# EasyEDA Pro project wukong01-Y003-HTOL - 2.eprj, board PCB1 (continued)
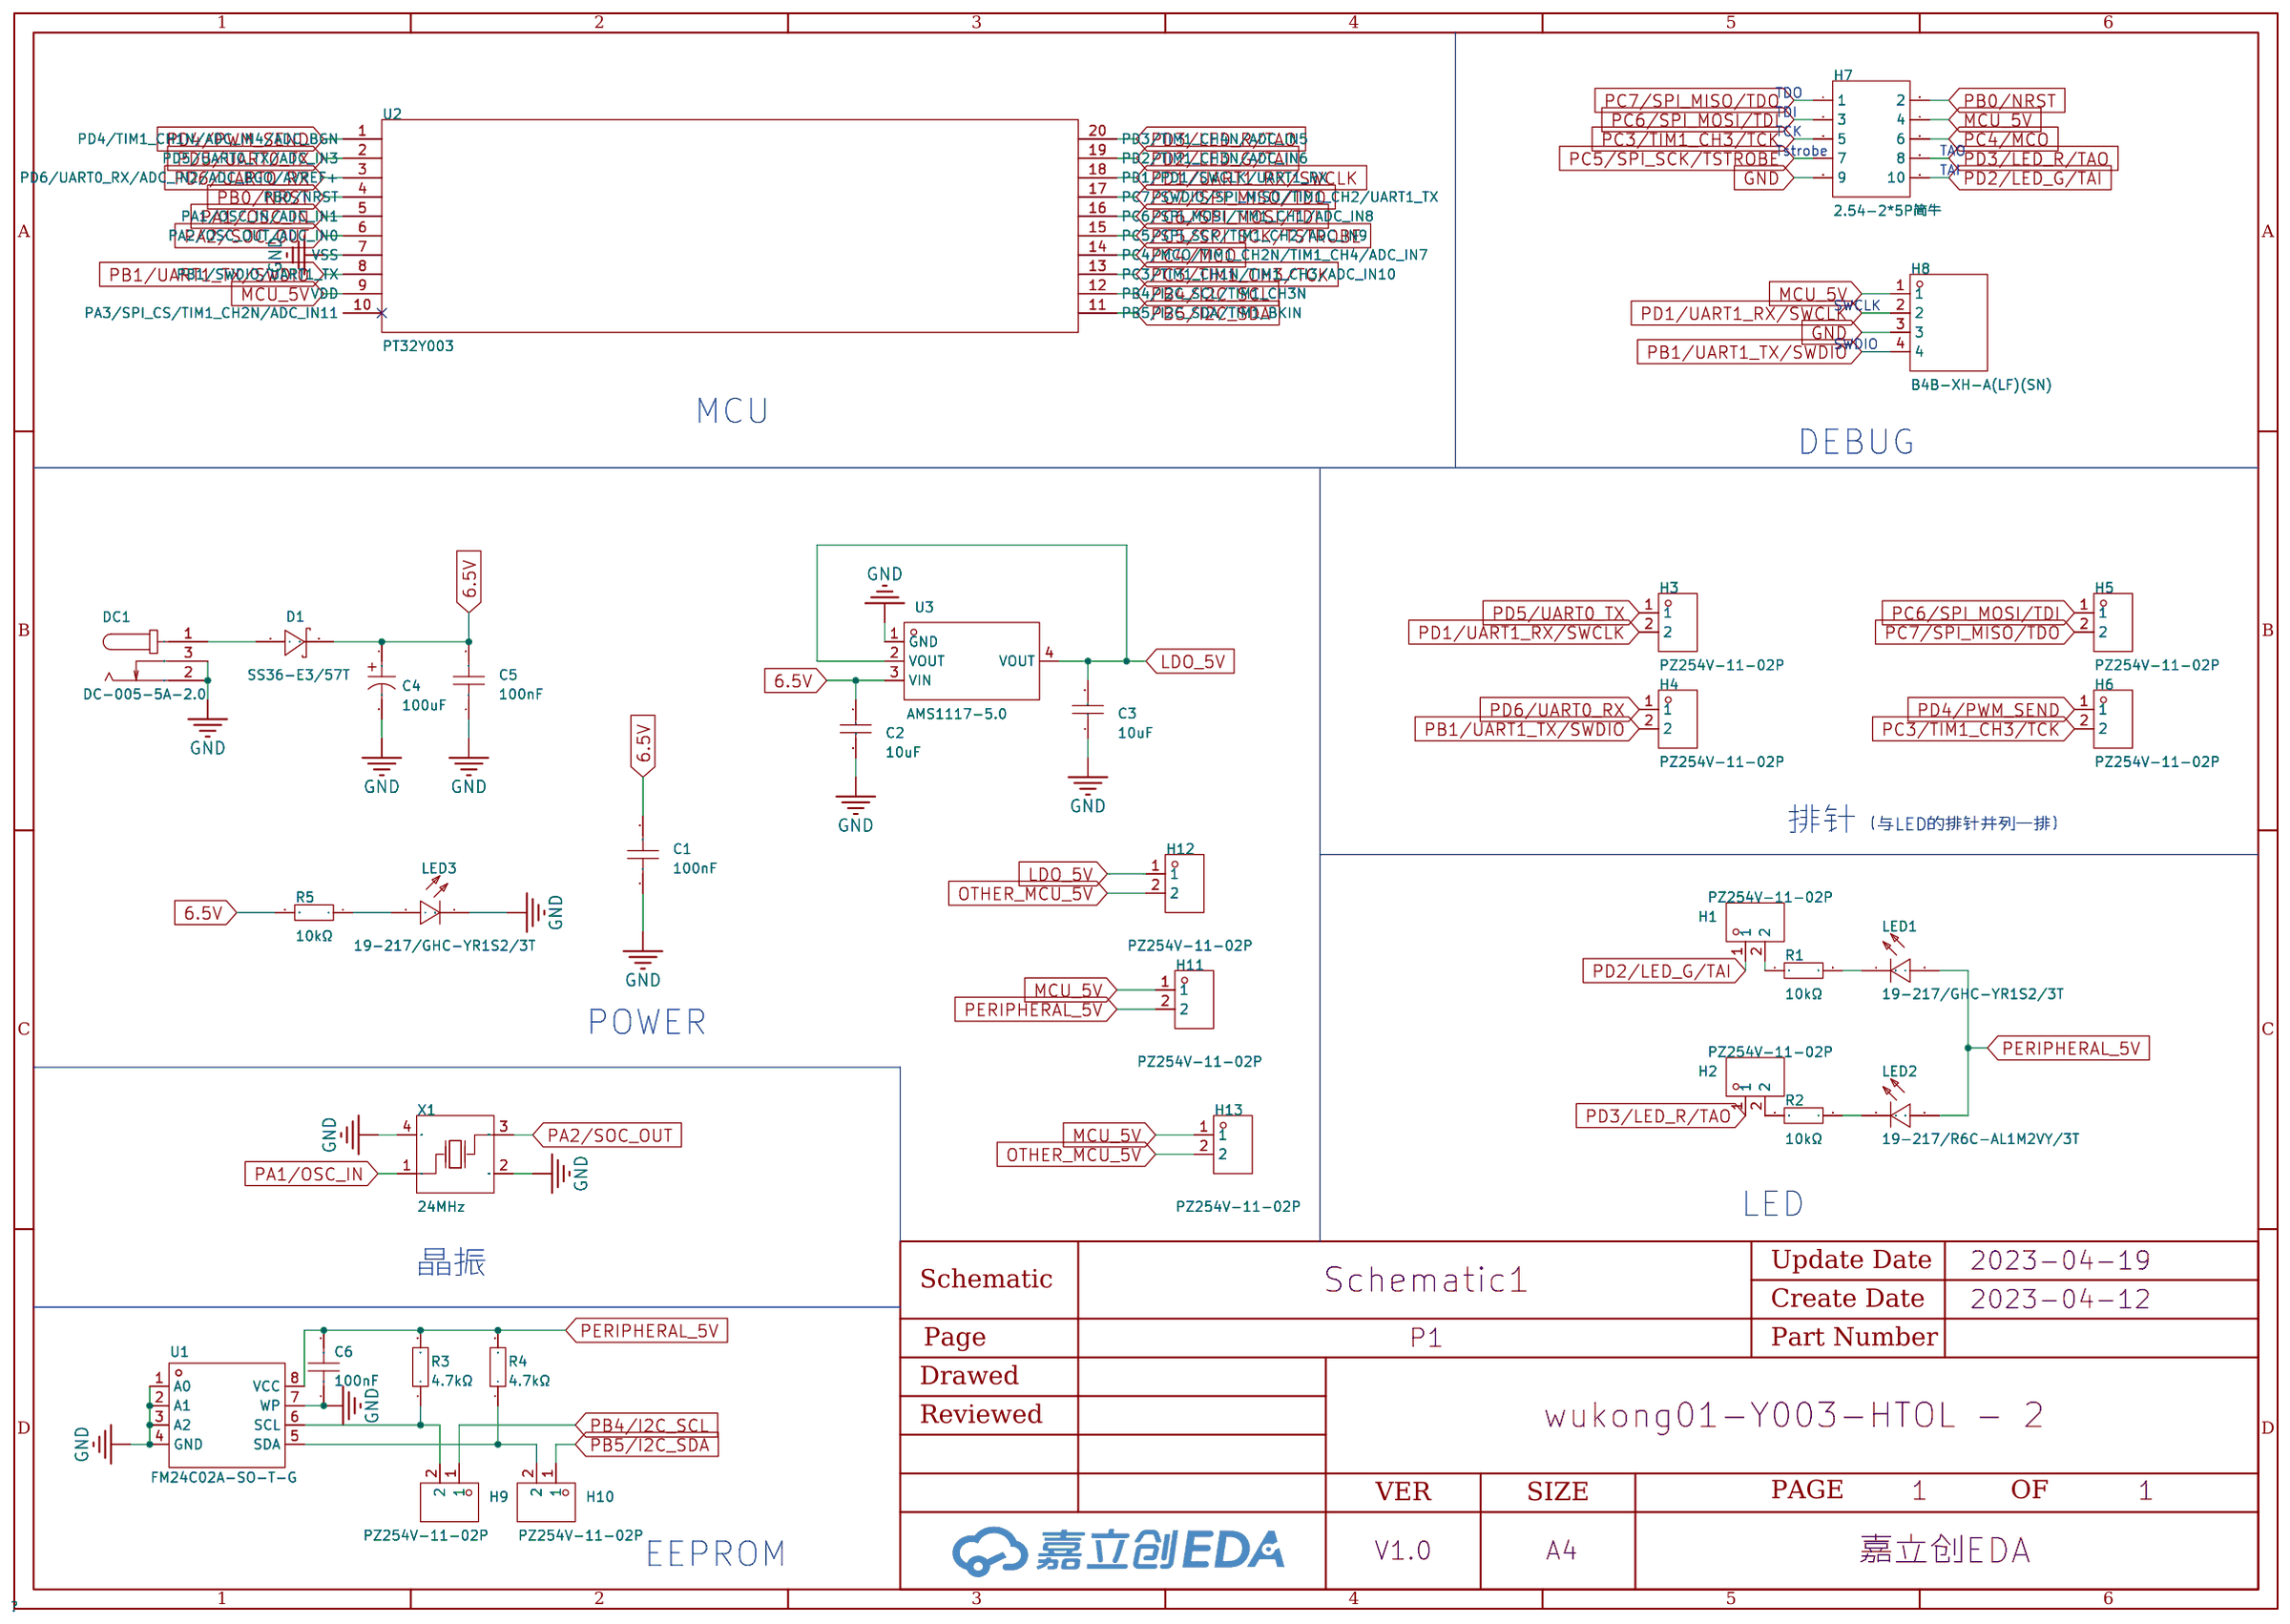
[diagram p0: schematic sheet]
## Nets (continued)
PC6/SPI_MOSI/TDI: H5.1 H5#2.1 H5#3.1 H5#4.1 H5#5.1 H5#6.1 H5#7.1 H5#8.1 H5#9.1 H5#10.1 H5#11.1 H5#12.1 H5#13.1 H5#14.1 H5#15.1 H5#16.1 H5#17.1 H5#18.1 H5#19.1 H5#20.1 H5#21.1 H5#22.1 H5#23.1 H5#24.1 H5#25.1 H5#26.1 H5#27.1 H5#28.1 H5#29.1 H5#30.1 H5#31.1 H5#32.1 H7.3 H7#2.3 H7#3.3 H7#4.3 H7#5.3 H7#6.3 H7#7.3 H7#8.3 H7#9.3 H7#10.3 H7#11.3 H7#12.3 H7#13.3 H7#14.3 H7#15.3 H7#16.3 H7#17.3 H7#18.3 H7#19.3 H7#20.3 H7#21.3 H7#22.3 H7#23.3 H7#24.3 H7#25.3 H7#26.3 H7#27.3 H7#28.3 H7#29.3 H7#30.3 H7#31.3 H7#32.3 U2.16 U2#2.16 U2#3.16 U2#4.16 U2#5.16 U2#6.16 U2#7.16 U2#8.16 U2#9.16 U2#10.16 U2#11.16 U2#12.16 U2#13.16 U2#14.16 U2#15.16 U2#16.16 U2#17.16 U2#18.16 U2#19.16 U2#20.16 U2#21.16 U2#22.16 U2#23.16 U2#24.16 U2#25.16 U2#26.16 U2#27.16 U2#28.16 U2#29.16 U2#30.16 U2#31.16 U2#32.16
PC7/SPI_MISO/TDO: H5.2 H5#2.2 H5#3.2 H5#4.2 H5#5.2 H5#6.2 H5#7.2 H5#8.2 H5#9.2 H5#10.2 H5#11.2 H5#12.2 H5#13.2 H5#14.2 H5#15.2 H5#16.2 H5#17.2 H5#18.2 H5#19.2 H5#20.2 H5#21.2 H5#22.2 H5#23.2 H5#24.2 H5#25.2 H5#26.2 H5#27.2 H5#28.2 H5#29.2 H5#30.2 H5#31.2 H5#32.2 H7.1 H7#2.1 H7#3.1 H7#4.1 H7#5.1 H7#6.1 H7#7.1 H7#8.1 H7#9.1 H7#10.1 H7#11.1 H7#12.1 H7#13.1 H7#14.1 H7#15.1 H7#16.1 H7#17.1 H7#18.1 H7#19.1 H7#20.1 H7#21.1 H7#22.1 H7#23.1 H7#24.1 H7#25.1 H7#26.1 H7#27.1 H7#28.1 H7#29.1 H7#30.1 H7#31.1 H7#32.1 U2.17 U2#2.17 U2#3.17 U2#4.17 U2#5.17 U2#6.17 U2#7.17 U2#8.17 U2#9.17 U2#10.17 U2#11.17 U2#12.17 U2#13.17 U2#14.17 U2#15.17 U2#16.17 U2#17.17 U2#18.17 U2#19.17 U2#20.17 U2#21.17 U2#22.17 U2#23.17 U2#24.17 U2#25.17 U2#26.17 U2#27.17 U2#28.17 U2#29.17 U2#30.17 U2#31.17 U2#32.17
PD1/UART1_RX/SWCLK: H3.2 H3#2.2 H3#3.2 H3#4.2 H3#5.2 H3#6.2 H3#7.2 H3#8.2 H3#9.2 H3#10.2 H3#11.2 H3#12.2 H3#13.2 H3#14.2 H3#15.2 H3#16.2 H3#17.2 H3#18.2 H3#19.2 H3#20.2 H3#21.2 H3#22.2 H3#23.2 H3#24.2 H3#25.2 H3#26.2 H3#27.2 H3#28.2 H3#29.2 H3#30.2 H3#31.2 H3#32.2 H8.2 H8#2.2 H8#3.2 H8#4.2 H8#5.2 H8#6.2 H8#7.2 H8#8.2 H8#9.2 H8#10.2 H8#11.2 H8#12.2 H8#13.2 H8#14.2 H8#15.2 H8#16.2 H8#17.2 H8#18.2 H8#19.2 H8#20.2 H8#21.2 H8#22.2 H8#23.2 H8#24.2 H8#25.2 H8#26.2 H8#27.2 H8#28.2 H8#29.2 H8#30.2 H8#31.2 H8#32.2 U2.18 U2#2.18 U2#3.18 U2#4.18 U2#5.18 U2#6.18 U2#7.18 U2#8.18 U2#9.18 U2#10.18 U2#11.18 U2#12.18 U2#13.18 U2#14.18 U2#15.18 U2#16.18 U2#17.18 U2#18.18 U2#19.18 U2#20.18 U2#21.18 U2#22.18 U2#23.18 U2#24.18 U2#25.18 U2#26.18 U2#27.18 U2#28.18 U2#29.18 U2#30.18 U2#31.18 U2#32.18
PD2/LED_G/TAI: H1.1 H1#2.1 H1#3.1 H1#4.1 H1#5.1 H1#6.1 H1#7.1 H1#8.1 H1#9.1 H1#10.1 H1#11.1 H1#12.1 H1#13.1 H1#14.1 H1#15.1 H1#16.1 H1#17.1 H1#18.1 H1#19.1 H1#20.1 H1#21.1 H1#22.1 H1#23.1 H1#24.1 H1#25.1 H1#26.1 H1#27.1 H1#28.1 H1#29.1 H1#30.1 H1#31.1 H1#32.1 H7.10 H7#2.10 H7#3.10 H7#4.10 H7#5.10 H7#6.10 H7#7.10 H7#8.10 H7#9.10 H7#10.10 H7#11.10 H7#12.10 H7#13.10 H7#14.10 H7#15.10 H7#16.10 H7#17.10 H7#18.10 H7#19.10 H7#20.10 H7#21.10 H7#22.10 H7#23.10 H7#24.10 H7#25.10 H7#26.10 H7#27.10 H7#28.10 H7#29.10 H7#30.10 H7#31.10 H7#32.10 U2.19 U2#2.19 U2#3.19 U2#4.19 U2#5.19 U2#6.19 U2#7.19 U2#8.19 U2#9.19 U2#10.19 U2#11.19 U2#12.19 U2#13.19 U2#14.19 U2#15.19 U2#16.19 U2#17.19 U2#18.19 U2#19.19 U2#20.19 U2#21.19 U2#22.19 U2#23.19 U2#24.19 U2#25.19 U2#26.19 U2#27.19 U2#28.19 U2#29.19 U2#30.19 U2#31.19 U2#32.19
PD3/LED_R/TAO: H2.1 H2#2.1 H2#3.1 H2#4.1 H2#5.1 H2#6.1 H2#7.1 H2#8.1 H2#9.1 H2#10.1 H2#11.1 H2#12.1 H2#13.1 H2#14.1 H2#15.1 H2#16.1 H2#17.1 H2#18.1 H2#19.1 H2#20.1 H2#21.1 H2#22.1 H2#23.1 H2#24.1 H2#25.1 H2#26.1 H2#27.1 H2#28.1 H2#29.1 H2#30.1 H2#31.1 H2#32.1 H7.8 H7#2.8 H7#3.8 H7#4.8 H7#5.8 H7#6.8 H7#7.8 H7#8.8 H7#9.8 H7#10.8 H7#11.8 H7#12.8 H7#13.8 H7#14.8 H7#15.8 H7#16.8 H7#17.8 H7#18.8 H7#19.8 H7#20.8 H7#21.8 H7#22.8 H7#23.8 H7#24.8 H7#25.8 H7#26.8 H7#27.8 H7#28.8 H7#29.8 H7#30.8 H7#31.8 H7#32.8 U2.20 U2#2.20 U2#3.20 U2#4.20 U2#5.20 U2#6.20 U2#7.20 U2#8.20 U2#9.20 U2#10.20 U2#11.20 U2#12.20 U2#13.20 U2#14.20 U2#15.20 U2#16.20 U2#17.20 U2#18.20 U2#19.20 U2#20.20 U2#21.20 U2#22.20 U2#23.20 U2#24.20 U2#25.20 U2#26.20 U2#27.20 U2#28.20 U2#29.20 U2#30.20 U2#31.20 U2#32.20
PD4/PWM_SEND: H6.1 H6#2.1 H6#3.1 H6#4.1 H6#5.1 H6#6.1 H6#7.1 H6#8.1 H6#9.1 H6#10.1 H6#11.1 H6#12.1 H6#13.1 H6#14.1 H6#15.1 H6#16.1 H6#17.1 H6#18.1 H6#19.1 H6#20.1 H6#21.1 H6#22.1 H6#23.1 H6#24.1 H6#25.1 H6#26.1 H6#27.1 H6#28.1 H6#29.1 H6#30.1 H6#31.1 H6#32.1 U2.1 U2#2.1 U2#3.1 U2#4.1 U2#5.1 U2#6.1 U2#7.1 U2#8.1 U2#9.1 U2#10.1 U2#11.1 U2#12.1 U2#13.1 U2#14.1 U2#15.1 U2#16.1 U2#17.1 U2#18.1 U2#19.1 U2#20.1 U2#21.1 U2#22.1 U2#23.1 U2#24.1 U2#25.1 U2#26.1 U2#27.1 U2#28.1 U2#29.1 U2#30.1 U2#31.1 U2#32.1
PD5/UART0_TX: H3.1 H3#2.1 H3#3.1 H3#4.1 H3#5.1 H3#6.1 H3#7.1 H3#8.1 H3#9.1 H3#10.1 H3#11.1 H3#12.1 H3#13.1 H3#14.1 H3#15.1 H3#16.1 H3#17.1 H3#18.1 H3#19.1 H3#20.1 H3#21.1 H3#22.1 H3#23.1 H3#24.1 H3#25.1 H3#26.1 H3#27.1 H3#28.1 H3#29.1 H3#30.1 H3#31.1 H3#32.1 U2.2 U2#2.2 U2#3.2 U2#4.2 U2#5.2 U2#6.2 U2#7.2 U2#8.2 U2#9.2 U2#10.2 U2#11.2 U2#12.2 U2#13.2 U2#14.2 U2#15.2 U2#16.2 U2#17.2 U2#18.2 U2#19.2 U2#20.2 U2#21.2 U2#22.2 U2#23.2 U2#24.2 U2#25.2 U2#26.2 U2#27.2 U2#28.2 U2#29.2 U2#30.2 U2#31.2 U2#32.2
PD6/UART0_RX: H4.1 H4#2.1 H4#3.1 H4#4.1 H4#5.1 H4#6.1 H4#7.1 H4#8.1 H4#9.1 H4#10.1 H4#11.1 H4#12.1 H4#13.1 H4#14.1 H4#15.1 H4#16.1 H4#17.1 H4#18.1 H4#19.1 H4#20.1 H4#21.1 H4#22.1 H4#23.1 H4#24.1 H4#25.1 H4#26.1 H4#27.1 H4#28.1 H4#29.1 H4#30.1 H4#31.1 H4#32.1 U2.3 U2#2.3 U2#3.3 U2#4.3 U2#5.3 U2#6.3 U2#7.3 U2#8.3 U2#9.3 U2#10.3 U2#11.3 U2#12.3 U2#13.3 U2#14.3 U2#15.3 U2#16.3 U2#17.3 U2#18.3 U2#19.3 U2#20.3 U2#21.3 U2#22.3 U2#23.3 U2#24.3 U2#25.3 U2#26.3 U2#27.3 U2#28.3 U2#29.3 U2#30.3 U2#31.3 U2#32.3
PERIPHERAL_5V: C6.2 C6#2.2 C6#3.2 C6#4.2 C6#5.2 C6#6.2 C6#7.2 C6#8.2 C6#9.2 C6#10.2 C6#11.2 C6#12.2 C6#13.2 C6#14.2 C6#15.2 C6#16.2 C6#17.2 C6#18.2 C6#19.2 C6#20.2 C6#21.2 C6#22.2 C6#23.2 C6#24.2 C6#25.2 C6#26.2 C6#27.2 C6#28.2 C6#29.2 C6#30.2 C6#31.2 C6#32.2 H11.2 H11#2.2 H11#3.2 H11#4.2 H11#5.2 H11#6.2 H11#7.2 H11#8.2 H11#9.2 H11#10.2 H11#11.2 H11#12.2 H11#13.2 H11#14.2 H11#15.2 H11#16.2 H11#17.2 H11#18.2 H11#19.2 H11#20.2 H11#21.2 H11#22.2 H11#23.2 H11#24.2 H11#25.2 H11#26.2 H11#27.2 H11#28.2 H11#29.2 H11#30.2 H11#31.2 H11#32.2 LED1.2 LED1#2.2 LED1#3.2 LED1#4.2 LED1#5.2 LED1#6.2 LED1#7.2 LED1#8.2 LED1#9.2 LED1#10.2 LED1#11.2 LED1#12.2 LED1#13.2 LED1#14.2 LED1#15.2 LED1#16.2 LED1#17.2 LED1#18.2 LED1#19.2 LED1#20.2 LED1#21.2 LED1#22.2 LED1#23.2 LED1#24.2 LED1#25.2 LED1#26.2 LED1#27.2 LED1#28.2 LED1#29.2 LED1#30.2 LED1#31.2 LED1#32.2 LED2.1 LED2#2.1 LED2#3.1 LED2#4.1 LED2#5.1 LED2#6.1 LED2#7.1 LED2#8.1 LED2#9.1 LED2#10.1 LED2#11.1 LED2#12.1 LED2#13.1 LED2#14.1 LED2#15.1 LED2#16.1 LED2#17.1 LED2#18.1 LED2#19.1 LED2#20.1 LED2#21.1 LED2#22.1 LED2#23.1 LED2#24.1 LED2#25.1 LED2#26.1 LED2#27.1 LED2#28.1 LED2#29.1 LED2#30.1 LED2#31.1 LED2#32.1 R3.2 R3#2.2 R3#3.2 R3#4.2 R3#5.2 R3#6.2 R3#7.2 R3#8.2 R3#9.2 R3#10.2 R3#11.2 R3#12.2 R3#13.2 R3#14.2 R3#15.2 R3#16.2 R3#17.2 R3#18.2 R3#19.2 R3#20.2 R3#21.2 R3#22.2 R3#23.2 R3#24.2 R3#25.2 R3#26.2 R3#27.2 R3#28.2 R3#29.2 R3#30.2 R3#31.2 R3#32.2 R4.2 R4#2.2 R4#3.2 R4#4.2 R4#5.2 R4#6.2 R4#7.2 R4#8.2 R4#9.2 R4#10.2 R4#11.2 R4#12.2 R4#13.2 R4#14.2 R4#15.2 R4#16.2 R4#17.2 R4#18.2 R4#19.2 R4#20.2 R4#21.2 R4#22.2 R4#23.2 R4#24.2 R4#25.2 R4#26.2 R4#27.2 R4#28.2 R4#29.2 R4#30.2 R4#31.2 R4#32.2 U1.8 U1#2.8 U1#3.8 U1#4.8 U1#5.8 U1#6.8 U1#7.8 U1#8.8 U1#9.8 U1#10.8 U1#11.8 U1#12.8 U1#13.8 U1#14.8 U1#15.8 U1#16.8 U1#17.8 U1#18.8 U1#19.8 U1#20.8 U1#21.8 U1#22.8 U1#23.8 U1#24.8 U1#25.8 U1#26.8 U1#27.8 U1#28.8 U1#29.8 U1#30.8 U1#31.8 U1#32.8
$1N849: LED1.1 LED1#2.1 LED1#3.1 LED1#4.1 LED1#5.1 LED1#6.1 LED1#7.1 LED1#8.1 LED1#9.1 LED1#10.1 LED1#11.1 LED1#12.1 LED1#13.1 LED1#14.1 LED1#15.1 LED1#16.1 LED1#17.1 LED1#18.1 LED1#19.1 LED1#20.1 LED1#21.1 LED1#22.1 LED1#23.1 LED1#24.1 LED1#25.1 LED1#26.1 LED1#27.1 LED1#28.1 LED1#29.1 LED1#30.1 LED1#31.1 LED1#32.1 R1.2 R1#2.2 R1#3.2 R1#4.2 R1#5.2 R1#6.2 R1#7.2 R1#8.2 R1#9.2 R1#10.2 R1#11.2 R1#12.2 R1#13.2 R1#14.2 R1#15.2 R1#16.2 R1#17.2 R1#18.2 R1#19.2 R1#20.2 R1#21.2 R1#22.2 R1#23.2 R1#24.2 R1#25.2 R1#26.2 R1#27.2 R1#28.2 R1#29.2 R1#30.2 R1#31.2 R1#32.2
$1N852: LED2.2 LED2#2.2 LED2#3.2 LED2#4.2 LED2#5.2 LED2#6.2 LED2#7.2 LED2#8.2 LED2#9.2 LED2#10.2 LED2#11.2 LED2#12.2 LED2#13.2 LED2#14.2 LED2#15.2 LED2#16.2 LED2#17.2 LED2#18.2 LED2#19.2 LED2#20.2 LED2#21.2 LED2#22.2 LED2#23.2 LED2#24.2 LED2#25.2 LED2#26.2 LED2#27.2 LED2#28.2 LED2#29.2 LED2#30.2 LED2#31.2 LED2#32.2 R2.2 R2#2.2 R2#3.2 R2#4.2 R2#5.2 R2#6.2 R2#7.2 R2#8.2 R2#9.2 R2#10.2 R2#11.2 R2#12.2 R2#13.2 R2#14.2 R2#15.2 R2#16.2 R2#17.2 R2#18.2 R2#19.2 R2#20.2 R2#21.2 R2#22.2 R2#23.2 R2#24.2 R2#25.2 R2#26.2 R2#27.2 R2#28.2 R2#29.2 R2#30.2 R2#31.2 R2#32.2
$1N3085: H1.2 H1#2.2 H1#3.2 H1#4.2 H1#5.2 H1#6.2 H1#7.2 H1#8.2 H1#9.2 H1#10.2 H1#11.2 H1#12.2 H1#13.2 H1#14.2 H1#15.2 H1#16.2 H1#17.2 H1#18.2 H1#19.2 H1#20.2 H1#21.2 H1#22.2 H1#23.2 H1#24.2 H1#25.2 H1#26.2 H1#27.2 H1#28.2 H1#29.2 H1#30.2 H1#31.2 H1#32.2 R1.1 R1#2.1 R1#3.1 R1#4.1 R1#5.1 R1#6.1 R1#7.1 R1#8.1 R1#9.1 R1#10.1 R1#11.1 R1#12.1 R1#13.1 R1#14.1 R1#15.1 R1#16.1 R1#17.1 R1#18.1 R1#19.1 R1#20.1 R1#21.1 R1#22.1 R1#23.1 R1#24.1 R1#25.1 R1#26.1 R1#27.1 R1#28.1 R1#29.1 R1#30.1 R1#31.1 R1#32.1
$1N3176: H2.2 H2#2.2 H2#3.2 H2#4.2 H2#5.2 H2#6.2 H2#7.2 H2#8.2 H2#9.2 H2#10.2 H2#11.2 H2#12.2 H2#13.2 H2#14.2 H2#15.2 H2#16.2 H2#17.2 H2#18.2 H2#19.2 H2#20.2 H2#21.2 H2#22.2 H2#23.2 H2#24.2 H2#25.2 H2#26.2 H2#27.2 H2#28.2 H2#29.2 H2#30.2 H2#31.2 H2#32.2 R2.1 R2#2.1 R2#3.1 R2#4.1 R2#5.1 R2#6.1 R2#7.1 R2#8.1 R2#9.1 R2#10.1 R2#11.1 R2#12.1 R2#13.1 R2#14.1 R2#15.1 R2#16.1 R2#17.1 R2#18.1 R2#19.1 R2#20.1 R2#21.1 R2#22.1 R2#23.1 R2#24.1 R2#25.1 R2#26.1 R2#27.1 R2#28.1 R2#29.1 R2#30.1 R2#31.1 R2#32.1
$1N6085: LED3.2 R5.1
$1N6296: D1.1 DC1.1
$1N15873: H10.2 H10#2.2 H10#3.2 H10#4.2 H10#5.2 H10#6.2 H10#7.2 H10#8.2 H10#9.2 H10#10.2 H10#11.2 H10#12.2 H10#13.2 H10#14.2 H10#15.2 H10#16.2 H10#17.2 H10#18.2 H10#19.2 H10#20.2 H10#21.2 H10#22.2 H10#23.2 H10#24.2 H10#25.2 H10#26.2 H10#27.2 H10#28.2 H10#29.2 H10#30.2 H10#31.2 H10#32.2 R4.1 R4#2.1 R4#3.1 R4#4.1 R4#5.1 R4#6.1 R4#7.1 R4#8.1 R4#9.1 R4#10.1 R4#11.1 R4#12.1 R4#13.1 R4#14.1 R4#15.1 R4#16.1 R4#17.1 R4#18.1 R4#19.1 R4#20.1 R4#21.1 R4#22.1 R4#23.1 R4#24.1 R4#25.1 R4#26.1 R4#27.1 R4#28.1 R4#29.1 R4#30.1 R4#31.1 R4#32.1 U1.5 U1#2.5 U1#3.5 U1#4.5 U1#5.5 U1#6.5 U1#7.5 U1#8.5 U1#9.5 U1#10.5 U1#11.5 U1#12.5 U1#13.5 U1#14.5 U1#15.5 U1#16.5 U1#17.5 U1#18.5 U1#19.5 U1#20.5 U1#21.5 U1#22.5 U1#23.5 U1#24.5 U1#25.5 U1#26.5 U1#27.5 U1#28.5 U1#29.5 U1#30.5 U1#31.5 U1#32.5
$1N15897: H9.2 H9#2.2 H9#3.2 H9#4.2 H9#5.2 H9#6.2 H9#7.2 H9#8.2 H9#9.2 H9#10.2 H9#11.2 H9#12.2 H9#13.2 H9#14.2 H9#15.2 H9#16.2 H9#17.2 H9#18.2 H9#19.2 H9#20.2 H9#21.2 H9#22.2 H9#23.2 H9#24.2 H9#25.2 H9#26.2 H9#27.2 H9#28.2 H9#29.2 H9#30.2 H9#31.2 H9#32.2 R3.1 R3#2.1 R3#3.1 R3#4.1 R3#5.1 R3#6.1 R3#7.1 R3#8.1 R3#9.1 R3#10.1 R3#11.1 R3#12.1 R3#13.1 R3#14.1 R3#15.1 R3#16.1 R3#17.1 R3#18.1 R3#19.1 R3#20.1 R3#21.1 R3#22.1 R3#23.1 R3#24.1 R3#25.1 R3#26.1 R3#27.1 R3#28.1 R3#29.1 R3#30.1 R3#31.1 R3#32.1 U1.6 U1#2.6 U1#3.6 U1#4.6 U1#5.6 U1#6.6 U1#7.6 U1#8.6 U1#9.6 U1#10.6 U1#11.6 U1#12.6 U1#13.6 U1#14.6 U1#15.6 U1#16.6 U1#17.6 U1#18.6 U1#19.6 U1#20.6 U1#21.6 U1#22.6 U1#23.6 U1#24.6 U1#25.6 U1#26.6 U1#27.6 U1#28.6 U1#29.6 U1#30.6 U1#31.6 U1#32.6
$1N18184: J2.1
$1N18185: J1.1

Pads without a net: U2 10; U2#2 10; U2#3 10; U2#4 10; U2#5 10; U2#6 10; U2#7 10; U2#8 10; U2#9 10; U2#10 10; U2#11 10; U2#12 10; U2#13 10; U2#14 10; U2#15 10; U2#16 10; U2#17 10; U2#18 10; U2#19 10; U2#20 10; U2#21 10; U2#22 10; U2#23 10; U2#24 10; U2#25 10; U2#26 10; U2#27 10; U2#28 10; U2#29 10; U2#30 10; U2#31 10; U2#32 10

## Via types
v1: diameter 0.61, hole 0.305, Top Layer to Bottom Layer, 2026 vias

## Routing (per net, layer and track width the routed paths; a pad name or vN(x,y) marks a point on that pad's centre or on a via; arc(x,y) is an arc through that point)
6.5V: length 88.5
  Top Layer w0.5: 35.17,205.37 35.17,209.08 35.26,209.17 ; 53.34,209.17 35.26,209.17 ; 53.34,209.17 53.34,212.09 44.39,221.04 U3#4.3 44.37,224.54 D1.2 28.45,217.43 C4.1 ; 53.34,209.17 53.34,205.56 U3#3.3 ; 35.26,209.17 18.92,209.17 17.91,208.15 17.91,205.13 U3.3
GND: length 4404.9
  Top Layer w0.5: U1#4.2 U1#4.1 196.38,206.27 v1(196.38,208.28) ; U1#4.2 206.48,204.98 207.24,205.74 ; U1#4.2 U1#4.3 U1#4.4 196.4,194.06 ; U1#12.2 U1#12.3 U1#12.4 61.4,118.06 ; U1#12.2 U1#12.7 71.48,128.98 C6#11.1 ; U1#12.2 U1#12.1 61.38,130.27 v1(61.38,132.28) ; 14.73,212.09 C4.2 32.28,212.09 ; 14.73,212.09 DC1.3 14.73,221.47 DC1.2 11.73,225.98 14.99,229.23 44.27,229.23 U3#4.1 45.2,229.94 C3#4.1 ; 14.73,212.09 7.74,212.09 2.92,207.26 v1(2.92,197.36) ; H7#22.9 253.7,109.52 H8#22.3 241.38,109.52 v1(241.38,98.83) 243.69,98.83 X1#22.2 ; U1#22.2 U1#22.1 16.38,92.27 v1(16.38,94.28) ; U1#22.2 U1#22.3 U1#22.4 16.4,80.14 ; U1#22.2 U1#22.7 26.48,90.98 27.24,91.74 ; v1(248.2,135.07) 245.95,135.07 X1#16.4 ; X1#18.4 20.95,97.07 v1(23.2,97.07) ; 207.24,91.74 206.48,90.98 U1#21.2 ; U2#23.7 v1(72.31,58.61) ; U1#14.2 161.48,128.98 162.24,129.74 ; U1#14.2 U1#14.3 U1#14.4 151.4,118.06 ; U1#14.2 U1#14.1 151.38,130.27 v1(151.38,132.28) ; v1(68.2,135.07) 65.95,135.07 X1#15.4 ; 27.24,167.74 26.48,166.98 U1#10.7 U1#10.2 ; U1#10.2 U1#10.3 U1#10.4 16.4,156.06 ; U1#10.2 U1#10.1 16.38,168.27 v1(16.38,170.28) ; X1#31.4 155.95,21.07 v1(158.2,21.07) ; H7#13.9 163.7,147.52 H8#15.3 151.38,147.52 v1(151.38,136.83) 153.69,136.83 X1#14.2 ; C6#23.1 71.48,52.98 U1#24.7 U1#24.2 ; v1(61.38,18.28) 61.38,16.27 U1#29.1 U1#29.2 ; v1(113.2,97.07) 110.95,97.07 X1#17.4 ; H7#19.9 163.7,109.52 H8#21.3 151.38,109.52 v1(151.38,98.83) 153.69,98.83 X1#20.2 ; U1.2 U1.3 U1.4 61.4,194.06 ; U1.2 U1.1 61.38,206.27 v1(61.38,208.28) ; U1.2 U1.7 71.48,204.98 C6#2.1 ; U1#29.2 U1#29.7 71.48,14.98 C6#29.1 ; U1#29.2 U1#29.3 U1#29.4 61.4,4.82 62.41,3.81 240.92,3.81 242.7,5.59 242.7,40.89 241.68,41.91 12.32,41.91 8.64,45.59 8.64,76.83 11.94,80.14 16.4,80.14 ; U1#26.2 U1#26.3 U1#26.4 151.4,42.06 ; U1#26.2 161.48,52.98 162.24,53.74 ; U1#26.2 U1#26.1 151.38,54.27 v1(151.38,56.28) ; H7#27.9 28.7,71.52 H8#26.3 16.38,71.52 v1(16.38,60.83) 18.69,60.83 X1#24.2 ; 196.4,156.06 U1#9.4 U1#9.3 U1#9.2 ; 106.4,4.06 U1#30.4 U1#30.3 U1#30.2 ; U2#19.7 v1(162.3,96.61) ; U1#6.2 U1#6.3 U1#6.4 61.4,156.06 ; U1#6.2 U1#6.7 71.48,166.98 C6#5.1 ; U1#6.2 U1#6.1 61.38,168.27 v1(61.38,170.28) ; U2#14.7 v1(207.3,134.61) ; C6#30.1 116.48,14.98 U1#30.7 U1#30.2 ; U2#24.7 v1(117.31,58.61) ; U2#30.7 v1(117.31,20.61) ; U2#32.7 v1(207.3,20.61) ; H7#11.9 73.7,147.52 H8#11.3 61.38,147.52 v1(61.38,136.83) 63.69,136.83 63.71,136.81 ; 196.4,118.06 U1#15.4 U1#15.3 U1#15.2 ; v1(241.38,132.28) 241.38,130.27 U1#11.1 U1#11.2 ; U2#8.7 v1(207.3,172.61) ; U1#7.2 U1#7.3 U1#7.4 106.4,156.06 ; U1#7.2 U1#7.7 116.48,166.98 C6#6.1 ; U1#7.2 U1#7.1 106.38,168.27 v1(106.38,170.28) ; U1#17.2 U1#17.1 241.38,92.27 v1(241.38,94.28) ; U1#17.2 251.48,90.98 C6#21.1 ; U1#17.2 U1#17.3 U1#17.4 241.4,80.01 ; v1(8.76,197.36) C3.1 ; H7#3.9 163.7,223.52 H8#3.3 151.38,223.52 v1(151.38,212.83) 153.69,212.83 X1#3.2 ; C6#12.1 116.48,128.98 U1#13.7 U1#13.2 ; v1(158.2,211.07) 155.95,211.07 X1#3.4 ; X1#28.2 243.69,60.83 v1(241.38,60.83) 241.38,71.52 H8#28.3 253.7,71.52 H7#28.9 ; U2#4.7 v1(207.3,210.61) ; H7#10.9 253.7,185.52 H8#10.3 241.38,185.52 v1(241.38,174.83) 243.69,174.83 X1#10.2 ; 196.4,194.06 151.4,194.06 ; 196.4,194.06 284.61,194.06 286.38,192.28 286.38,160.53 281.81,155.96 11.3,155.96 8.38,153.03 8.38,121.54 12.06,117.86 283.46,117.86 285.62,115.7 285.62,84.33 281.31,80.01 241.4,80.01 ; X1#18.2 18.69,98.83 v1(16.38,98.83) 16.38,109.52 H8#20.3 28.7,109.52 H7#21.9 ; v1(106.38,94.28) 106.38,92.27 U1#19.1 U1#19.2 ; X1#4.2 198.69,212.83 v1(196.38,212.83) 196.38,223.52 H8#4.3 208.7,223.52 H7#4.9 ; X1#21.4 65.95,97.07 v1(68.2,97.07) ; v1(158.2,135.07) 155.95,135.07 X1#14.4 ; v1(68.2,211.07) 65.95,211.07 X1.4 ; v1(16.38,132.28) 16.38,130.27 U1#16.1 U1#16.2 ; v1(158.2,97.07) 155.95,97.07 X1#20.4 ; U2#2.7 v1(117.31,210.61) ; U1#25.2 U1#25.1 106.38,54.27 v1(106.38,56.28) ; U1#25.2 U1#25.3 U1#25.4 106.4,42.06 ; U1#25.2 U1#25.7 116.48,52.98 C6#24.1 ; U2#28.7 v1(27.3,58.61) ; U1#31.2 U1#31.1 151.38,16.27 v1(151.38,18.28) ; U1#31.2 161.48,14.98 162.24,15.74 ; U1#31.2 U1#31.3 U1#31.4 151.4,4.06 ; v1(158.2,173.07) 155.95,173.07 X1#8.4 ; 106.4,194.06 151.4,194.06 ; 106.4,194.06 U1#2.4 U1#2.3 U1#2.2 ; 106.4,194.06 61.4,194.06 ; 151.4,194.06 U1#3.4 U1#3.3 U1#3.2 ; X1#10.4 245.95,173.07 v1(248.2,173.07) ; C6#15.1 251.48,128.98 U1#11.2 ; 32.28,212.09 32.51,212.32 C2.2 ; 32.28,212.09 35.68,212.09 ; U1#2.2 U1#2.7 116.48,204.98 C6#3.1 ; U1#2.2 U1#2.1 106.38,206.27 v1(106.38,208.28) ; 106.4,80.01 241.4,80.01 ; 106.4,80.01 U1#19.4 U1#19.3 U1#19.2 ; 106.4,80.01 61.53,80.01 61.4,80.14 ; 16.4,118.06 U1#16.4 U1#16.3 U1#16.2 ; X1#9.4 65.95,173.07 v1(68.2,173.07) ; 38.28,212.09 38.23,212.14 C5.1 ; 38.28,212.09 35.68,212.09 ; 38.28,212.09 40.89,212.09 C1.1 ; U1#11.2 U1#11.3 U1#11.4 241.4,118.06 ; 16.4,80.14 16.4,80.06 ; 16.4,80.14 61.4,80.14 ; U2#22.7 v1(27.3,96.61) ; v1(248.2,59.07) 245.95,59.07 X1#28.4 ; X1#30.2 198.69,22.83 v1(196.38,22.83) 196.38,33.52 H8#31.3 208.7,33.52 H7#32.9 ; U2#10.7 v1(27.3,172.61) ; 63.71,174.81 63.69,174.83 v1(61.38,174.83) 61.38,185.52 H8#5.3 73.7,185.52 H7#5.9 ; 108.71,212.81 108.69,212.83 v1(106.38,212.83) 106.38,223.52 H8#2.3 118.7,223.52 H7#2.9 ; U2#27.7 v1(252.31,58.61) ; v1(23.2,135.07) 20.95,135.07 X1#12.4 ; 61.4,80.14 U1#18.4 U1#18.3 U1#18.2 ; 61.4,80.14 61.4,80.06 ; H7#24.9 118.7,71.52 H8#24.3 106.38,71.52 v1(106.38,60.83) 108.69,60.83 108.71,60.81 ; U2#16.7 v1(27.3,134.61) ; X1#6.2 18.69,174.83 v1(16.38,174.83) 16.38,185.52 H8#8.3 28.7,185.52 H7#9.9 ; U1#23.2 251.48,52.98 C6#27.1 ; U1#23.2 U1#23.1 241.38,54.27 v1(241.38,56.28) ; U1#23.2 U1#23.3 U1#23.4 241.4,42.06 ; U2#6.7 v1(117.31,172.61) ; 196.4,4.06 U1#32.4 U1#32.3 U1#32.2 ; U2#11.7 v1(72.31,134.61) ; v1(61.38,94.28) 61.38,92.27 U1#18.1 U1#18.2 ; v1(248.2,97.07) 245.95,97.07 X1#22.4 ; X1#6.4 20.95,173.07 v1(23.2,173.07) ; v1(203.2,59.07) 200.95,59.07 X1#25.4 ; C3#2.1 v1(26.01,197.36) ; U3.1 v1(17.92,197.36) ; U1#13.2 U1#13.3 U1#13.4 106.4,118.06 ; U1#13.2 U1#13.1 106.38,130.27 v1(106.38,132.28) ; U1#30.2 U1#30.1 106.38,16.27 v1(106.38,18.28) ; 35.68,212.09 35.56,212.2 LED3.1 ; 63.71,22.81 63.69,22.83 v1(61.38,22.83) 61.38,33.52 H8#29.3 73.7,33.52 H7#29.9 ; U1#15.2 206.48,128.98 207.24,129.74 ; U1#15.2 U1#15.1 196.38,130.27 v1(196.38,132.28) ; U1#21.2 U1#21.1 196.38,92.27 v1(196.38,94.28) ; U1#21.2 U1#21.3 U1#21.4 196.4,80.06 ; X1#19.4 200.95,97.07 v1(203.2,97.07) ; v1(68.2,59.07) 65.95,59.07 X1#27.4 ; U1#3.2 161.48,204.98 162.24,205.74 ; U1#3.2 U1#3.1 151.38,206.27 v1(151.38,208.28) ; U3#3.1 53.4,199.45 51.31,197.36 v1(50.11,197.36) 50.16,197.3 50.16,195.2 51.31,194.06 61.4,194.06 ; U1#18.2 U1#18.7 71.48,90.98 C6#17.1 ; v1(68.2,21.07) 65.95,21.07 X1#32.4 ; U2#12.7 v1(117.31,134.61) ; H7#15.9 28.7,147.52 H8#14.3 16.38,147.52 v1(16.38,136.83) 18.69,136.83 X1#12.2 ; v1(113.2,173.07) 110.95,173.07 X1#5.4 ; U1#8.2 U1#8.1 151.38,168.27 v1(151.38,170.28) ; U1#8.2 U1#8.3 U1#8.4 151.4,156.06 ; U1#8.2 161.48,166.98 162.24,167.74 ; U1#20.2 U1#20.1 151.38,92.27 v1(151.38,94.28) ; U1#20.2 161.48,90.98 162.24,91.74 ; U1#20.2 U1#20.3 U1#20.4 151.4,80.06 ; X1#23.4 110.95,59.07 v1(113.2,59.07) ; 108.71,136.81 108.69,136.83 v1(106.38,136.83) 106.38,147.52 H8#12.3 118.7,147.52 H7#12.9 ; U2#9.7 v1(252.31,172.61) ; H7#6.9 118.7,185.52 H8#6.3 106.38,185.52 v1(106.38,174.83) 108.69,174.83 108.71,174.81 ; v1(23.2,59.07) 20.95,59.07 X1#24.4 ; v1(113.2,135.07) 110.95,135.07 X1#11.4 ; v1(196.38,170.28) 196.38,168.27 U1#9.1 U1#9.2 ; 35.17,200.77 v1(35.17,197.36) ; X1#31.2 153.69,22.83 v1(151.38,22.83) 151.38,33.52 H8#32.3 163.7,33.52 H7#31.9 ; 207.24,15.74 206.48,14.98 U1#32.2 ; C6#18.1 116.48,90.98 U1#19.7 U1#19.2 ; X1#16.2 243.69,136.83 v1(241.38,136.83) 241.38,147.52 H8#16.3 253.7,147.52 H7#16.9 ; v1(113.2,21.07) 110.95,21.07 X1#29.4 ; v1(203.2,211.07) 200.95,211.07 X1#4.4 ; 61.4,42.06 U1#24.4 U1#24.3 U1#24.2 ; U1#32.2 U1#32.1 196.38,16.27 v1(196.38,18.28) ; H7#7.9 163.7,185.52 H8#9.3 151.38,185.52 v1(151.38,174.83) 153.69,174.83 X1#8.2 ; H7#20.9 208.7,109.52 H8#19.3 196.38,109.52 v1(196.38,98.83) 198.69,98.83 X1#19.2 ; U2#31.7 v1(162.3,20.61) ; U2#26.7 v1(207.3,58.61) ; U2#18.7 v1(117.31,96.61) ; U2.7 v1(72.31,210.61) ; v1(203.2,173.07) 200.95,173.07 X1#7.4 ; H7#18.9 118.7,109.52 H8#18.3 106.38,109.52 v1(106.38,98.83) 108.69,98.83 108.71,98.81 ; H7#14.9 208.7,147.52 H8#13.3 196.38,147.52 v1(196.38,136.83) 198.69,136.83 X1#13.2 ; 16.4,42.06 U1#28.4 U1#28.3 U1#28.2 ; H7#8.9 208.7,185.52 H8#7.3 196.38,185.52 v1(196.38,174.83) 198.69,174.83 X1#7.2 ; C3#3.1 v1(44.24,197.36) ; U1#16.2 U1#16.7 26.48,128.98 27.24,129.74 ; 63.71,60.81 63.69,60.83 v1(61.38,60.83) 61.38,71.52 H8#23.3 73.7,71.52 H7#23.9 ; U1#9.2 206.48,166.98 207.24,167.74 ; X1#30.4 200.95,21.07 v1(203.2,21.07) ; 63.71,98.81 63.69,98.83 v1(61.38,98.83) 61.38,109.52 H8#17.3 73.7,109.52 H7#17.9 ; U2#21.7 v1(252.31,96.61) ; U1#5.2 U1#5.3 U1#5.4 241.4,156.06 ; U1#5.2 251.48,166.98 C6#9.1 ; U1#5.2 U1#5.1 241.38,168.27 v1(241.38,170.28) ; X1#13.4 200.95,135.07 v1(203.2,135.07) ; H7#26.9 208.7,71.52 H8#25.3 196.38,71.52 v1(196.38,60.83) 198.69,60.83 X1#25.2 ; U1#27.2 U1#27.3 U1#27.4 196.4,42.06 ; U1#27.2 U1#27.1 196.38,54.27 v1(196.38,56.28) ; U1#27.2 206.48,52.98 207.24,53.74 ; U1#24.2 U1#24.1 61.38,54.27 v1(61.38,56.28) ; X1#26.2 153.69,60.83 v1(151.38,60.83) 151.38,71.52 H8#27.3 163.7,71.52 H7#25.9 ; X1#2.4 110.95,211.07 v1(113.2,211.07) ; H7.9 73.7,223.52 H8.3 61.38,223.52 v1(61.38,212.83) 63.69,212.83 63.71,212.81 ; U2#17.7 v1(72.31,96.61) ; U2#5.7 v1(72.31,172.61) ; U2#15.7 v1(252.31,134.61) ; U1#28.2 U1#28.1 16.38,54.27 v1(16.38,56.28) ; U1#28.2 U1#28.7 26.48,52.98 27.24,53.74 ; v1(158.2,59.07) 155.95,59.07 X1#26.4 ; 108.71,22.81 108.69,22.83 v1(106.38,22.83) 106.38,33.52 H8#30.3 118.7,33.52 H7#30.9 ; U2#20.7 v1(207.3,96.61) ; U2#13.7 v1(162.3,134.61) ; U2#29.7 v1(72.31,20.61) ; U2#3.7 v1(162.3,210.61) ; U2#25.7 v1(162.3,58.61) ; U2#7.7 v1(162.3,172.61)
  Bottom Layer w0.5: 23.24,94.28 26.8,94.28 27.3,94.79 v1(27.3,96.61) ; 23.24,94.28 v1(16.38,94.28) v1(16.38,98.83) ; 23.24,94.28 23.2,94.32 v1(23.2,97.07) ; 203.24,208.28 v1(196.38,208.28) v1(196.38,212.83) ; 203.24,208.28 203.2,208.32 v1(203.2,211.07) ; 203.24,208.28 206.8,208.28 207.3,208.79 v1(207.3,210.61) ; v1(241.38,136.83) v1(241.38,132.28) 248.24,132.28 ; v1(117.31,58.61) 117.31,56.79 116.8,56.28 113.24,56.28 ; v1(241.38,60.83) v1(241.38,56.28) 248.24,56.28 ; 158.24,18.28 v1(151.38,18.28) v1(151.38,22.83) ; 158.24,18.28 158.2,18.32 v1(158.2,21.07) ; 158.24,18.28 161.8,18.28 162.3,18.79 v1(162.3,20.61) ; 23.24,170.28 v1(16.38,170.28) v1(16.38,174.83) ; 23.24,170.28 26.8,170.28 27.3,170.79 v1(27.3,172.61) ; 23.24,170.28 23.2,170.32 v1(23.2,173.07) ; v1(151.38,174.83) v1(151.38,170.28) 158.24,170.28 ; 68.24,132.28 v1(61.38,132.28) v1(61.38,136.83) ; 68.24,132.28 71.8,132.28 72.31,132.79 v1(72.31,134.61) ; 68.24,132.28 68.2,132.32 v1(68.2,135.07) ; 248.24,56.28 251.8,56.28 252.31,56.79 v1(252.31,58.61) ; 248.24,56.28 248.2,56.32 v1(248.2,59.07) ; 68.24,170.28 v1(61.38,170.28) v1(61.38,174.83) ; 68.24,170.28 71.8,170.28 72.31,170.79 v1(72.31,172.61) ; 68.24,170.28 68.2,170.32 v1(68.2,173.07) ; 113.24,56.28 v1(106.38,56.28) v1(106.38,60.83) ; 113.24,56.28 113.2,56.32 v1(113.2,59.07) ; 113.24,208.28 116.8,208.28 117.31,208.79 v1(117.31,210.61) ; 113.24,208.28 113.2,208.32 v1(113.2,211.07) ; 113.24,208.28 v1(106.38,208.28) v1(106.38,212.83) ; v1(61.38,212.83) v1(61.38,208.28) 68.24,208.28 ; 203.24,56.28 203.2,56.32 v1(203.2,59.07) ; 203.24,56.28 v1(196.38,56.28) v1(196.38,60.83) ; 203.24,56.28 206.8,56.28 207.3,56.79 v1(207.3,58.61) ; 23.24,132.28 26.8,132.28 27.3,132.79 v1(27.3,134.61) ; 23.24,132.28 v1(16.38,132.28) v1(16.38,136.83) ; 23.24,132.28 23.2,132.32 v1(23.2,135.07) ; 23.24,56.28 26.8,56.28 27.3,56.79 v1(27.3,58.61) ; 23.24,56.28 v1(16.38,56.28) v1(16.38,60.83) ; 23.24,56.28 23.2,56.32 v1(23.2,59.07) ; 68.24,18.28 71.8,18.28 72.31,18.79 v1(72.31,20.61) ; 68.24,18.28 68.2,18.32 v1(68.2,21.07) ; 68.24,18.28 v1(61.38,18.28) v1(61.38,22.83) ; 248.24,170.28 v1(241.38,170.28) v1(241.38,174.83) ; 248.24,170.28 251.8,170.28 252.31,170.79 v1(252.31,172.61) ; 248.24,170.28 248.2,170.32 v1(248.2,173.07) ; v1(151.38,98.83) v1(151.38,94.28) 158.24,94.28 ; 68.24,208.28 68.2,208.32 v1(68.2,211.07) ; 68.24,208.28 71.8,208.28 72.31,208.79 v1(72.31,210.61) ; 203.24,18.28 203.2,18.32 v1(203.2,21.07) ; 203.24,18.28 v1(196.38,18.28) v1(196.38,22.83) ; 203.24,18.28 206.8,18.28 207.3,18.79 v1(207.3,20.61) ; 248.24,132.28 251.8,132.28 252.31,132.79 v1(252.31,134.61) ; 248.24,132.28 248.2,132.32 v1(248.2,135.07) ; 203.24,94.28 v1(196.38,94.28) v1(196.38,98.83) ; 203.24,94.28 206.8,94.28 207.3,94.79 v1(207.3,96.61) ; 203.24,94.28 203.2,94.32 v1(203.2,97.07) ; v1(151.38,60.83) v1(151.38,56.28) 158.24,56.28 ; v1(113.2,173.07) 113.2,170.32 113.24,170.28 ; 68.24,56.28 v1(61.38,56.28) v1(61.38,60.83) ; 68.24,56.28 68.2,56.32 v1(68.2,59.07) ; 68.24,56.28 71.8,56.28 72.31,56.79 v1(72.31,58.61) ; v1(106.38,136.83) v1(106.38,132.28) 113.24,132.28 ; 158.24,170.28 161.8,170.28 162.3,170.79 v1(162.3,172.61) ; 158.24,170.28 158.2,170.32 v1(158.2,173.07) ; 113.24,94.28 v1(106.38,94.28) v1(106.38,98.83) ; 113.24,94.28 116.8,94.28 117.31,94.79 v1(117.31,96.61) ; 113.24,94.28 113.2,94.32 v1(113.2,97.07) ; 113.24,18.28 113.2,18.32 v1(113.2,21.07) ; 113.24,18.28 v1(106.38,18.28) v1(106.38,22.83) ; 113.24,18.28 116.8,18.28 117.31,18.79 v1(117.31,20.61) ; v1(203.2,135.07) 203.2,132.32 203.24,132.28 ; 158.24,56.28 161.8,56.28 162.3,56.79 v1(162.3,58.61) ; 158.24,56.28 158.2,56.32 v1(158.2,59.07) ; 158.24,208.28 158.2,208.32 v1(158.2,211.07) ; 158.24,208.28 161.8,208.28 162.3,208.79 v1(162.3,210.61) ; 158.24,208.28 v1(151.38,208.28) v1(151.38,212.83) ; 203.24,132.28 206.8,132.28 207.3,132.79 v1(207.3,134.61) ; 203.24,132.28 v1(196.38,132.28) v1(196.38,136.83) ; v1(151.38,136.83) v1(151.38,132.28) 158.24,132.28 ; v1(2.92,197.36) v1(8.76,197.36) v1(17.92,197.36) v1(26.01,197.36) v1(35.17,197.36) v1(44.24,197.36) v1(50.11,197.36) ; v1(203.2,173.07) 203.2,170.32 203.24,170.28 ; 68.24,94.28 71.8,94.28 72.31,94.79 v1(72.31,96.61) ; 68.24,94.28 v1(61.38,94.28) v1(61.38,98.83) ; 68.24,94.28 68.2,94.32 v1(68.2,97.07) ; v1(241.38,98.83) v1(241.38,94.28) 248.24,94.28 ; v1(158.2,97.07) 158.2,94.32 158.24,94.28 ; 158.24,94.28 161.8,94.28 162.3,94.79 v1(162.3,96.61) ; 158.24,132.28 158.2,132.32 v1(158.2,135.07) ; 158.24,132.28 161.8,132.28 162.3,132.79 v1(162.3,134.61) ; 203.24,170.28 206.8,170.28 207.3,170.79 v1(207.3,172.61) ; 203.24,170.28 v1(196.38,170.28) v1(196.38,174.83) ; 113.24,132.28 116.8,132.28 117.31,132.79 v1(117.31,134.61) ; 113.24,132.28 113.2,132.32 v1(113.2,135.07) ; 248.24,94.28 248.2,94.32 v1(248.2,97.07) ; 248.24,94.28 251.8,94.28 252.31,94.79 v1(252.31,96.61) ; 113.24,170.28 116.8,170.28 117.31,170.79 v1(117.31,172.61) ; 113.24,170.28 v1(106.38,170.28) v1(106.38,174.83)